# EasyEDA Pro project 第十四届蓝桥杯EDA国赛练习2.eprj, schematic SCH

## Sheets
1 POWER: Create Date: 2024-05-06; Page Name: POWER; Project Name: 第十四届蓝桥杯EDA国赛练习2; Schematic Name: SCH; Update Date: 2024-05-13
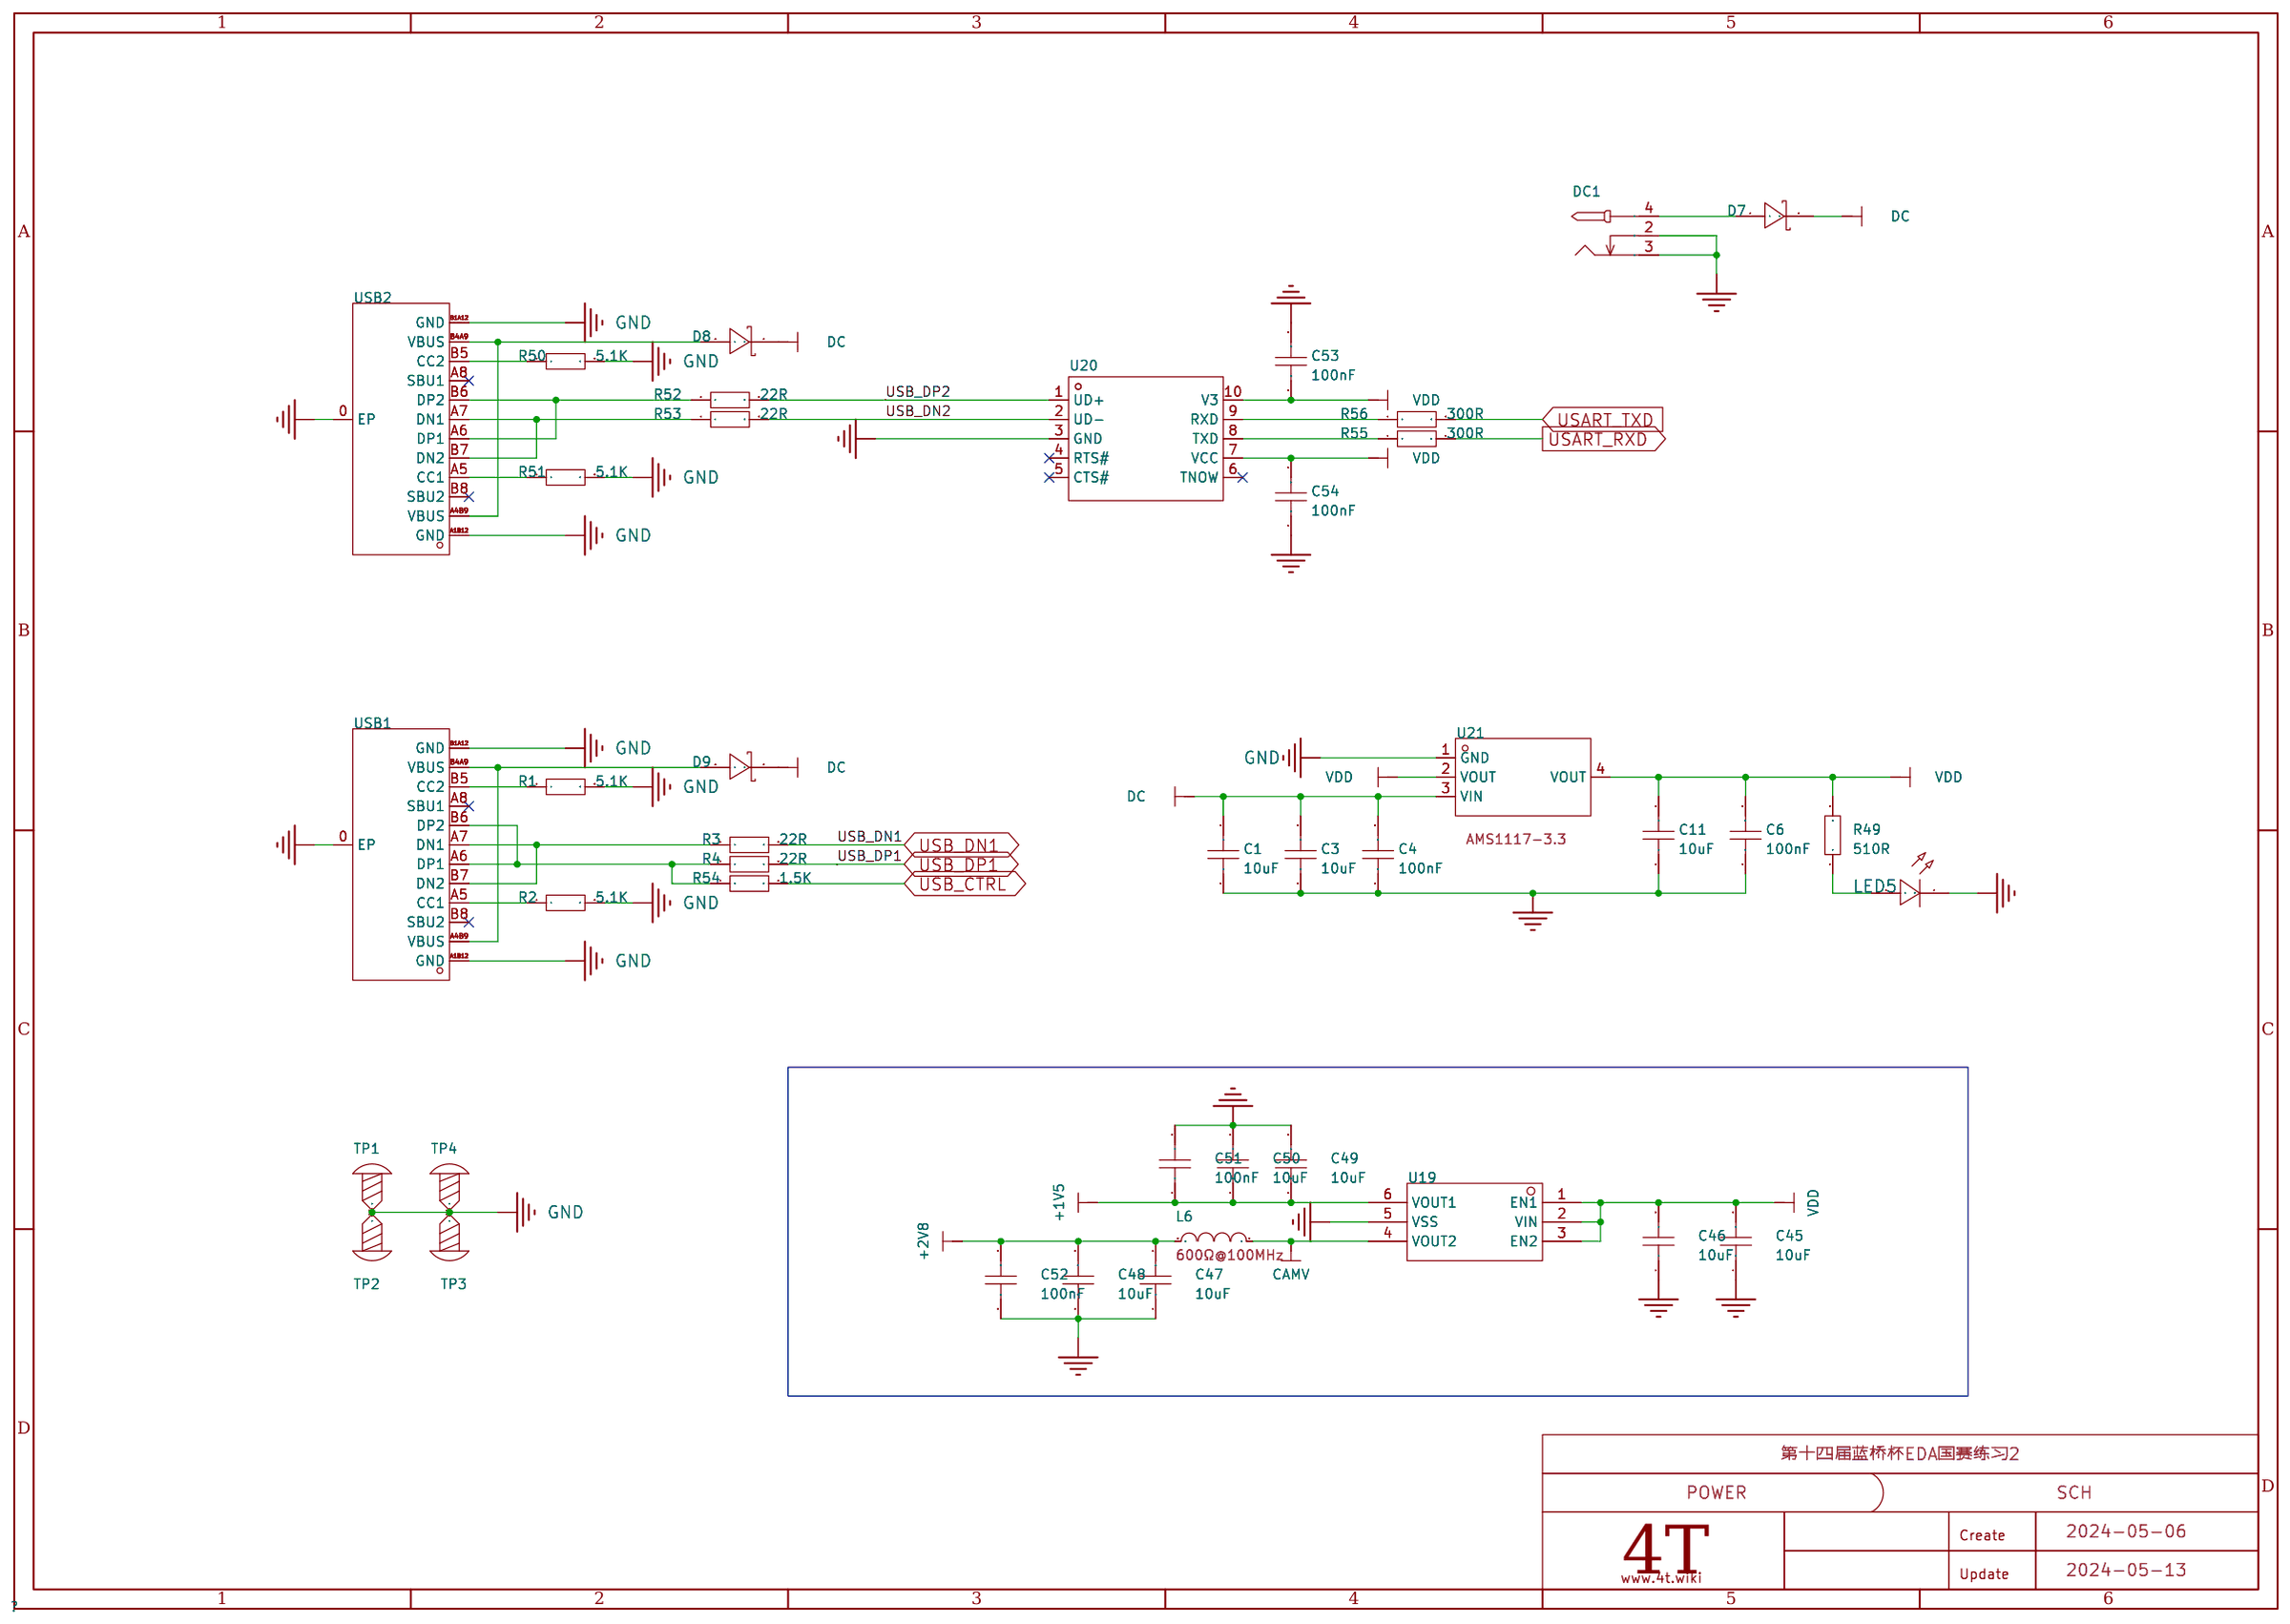
[diagram p0: POWER]
2 RELAY: Page Name: RELAY; Update Date: 2024-05-07
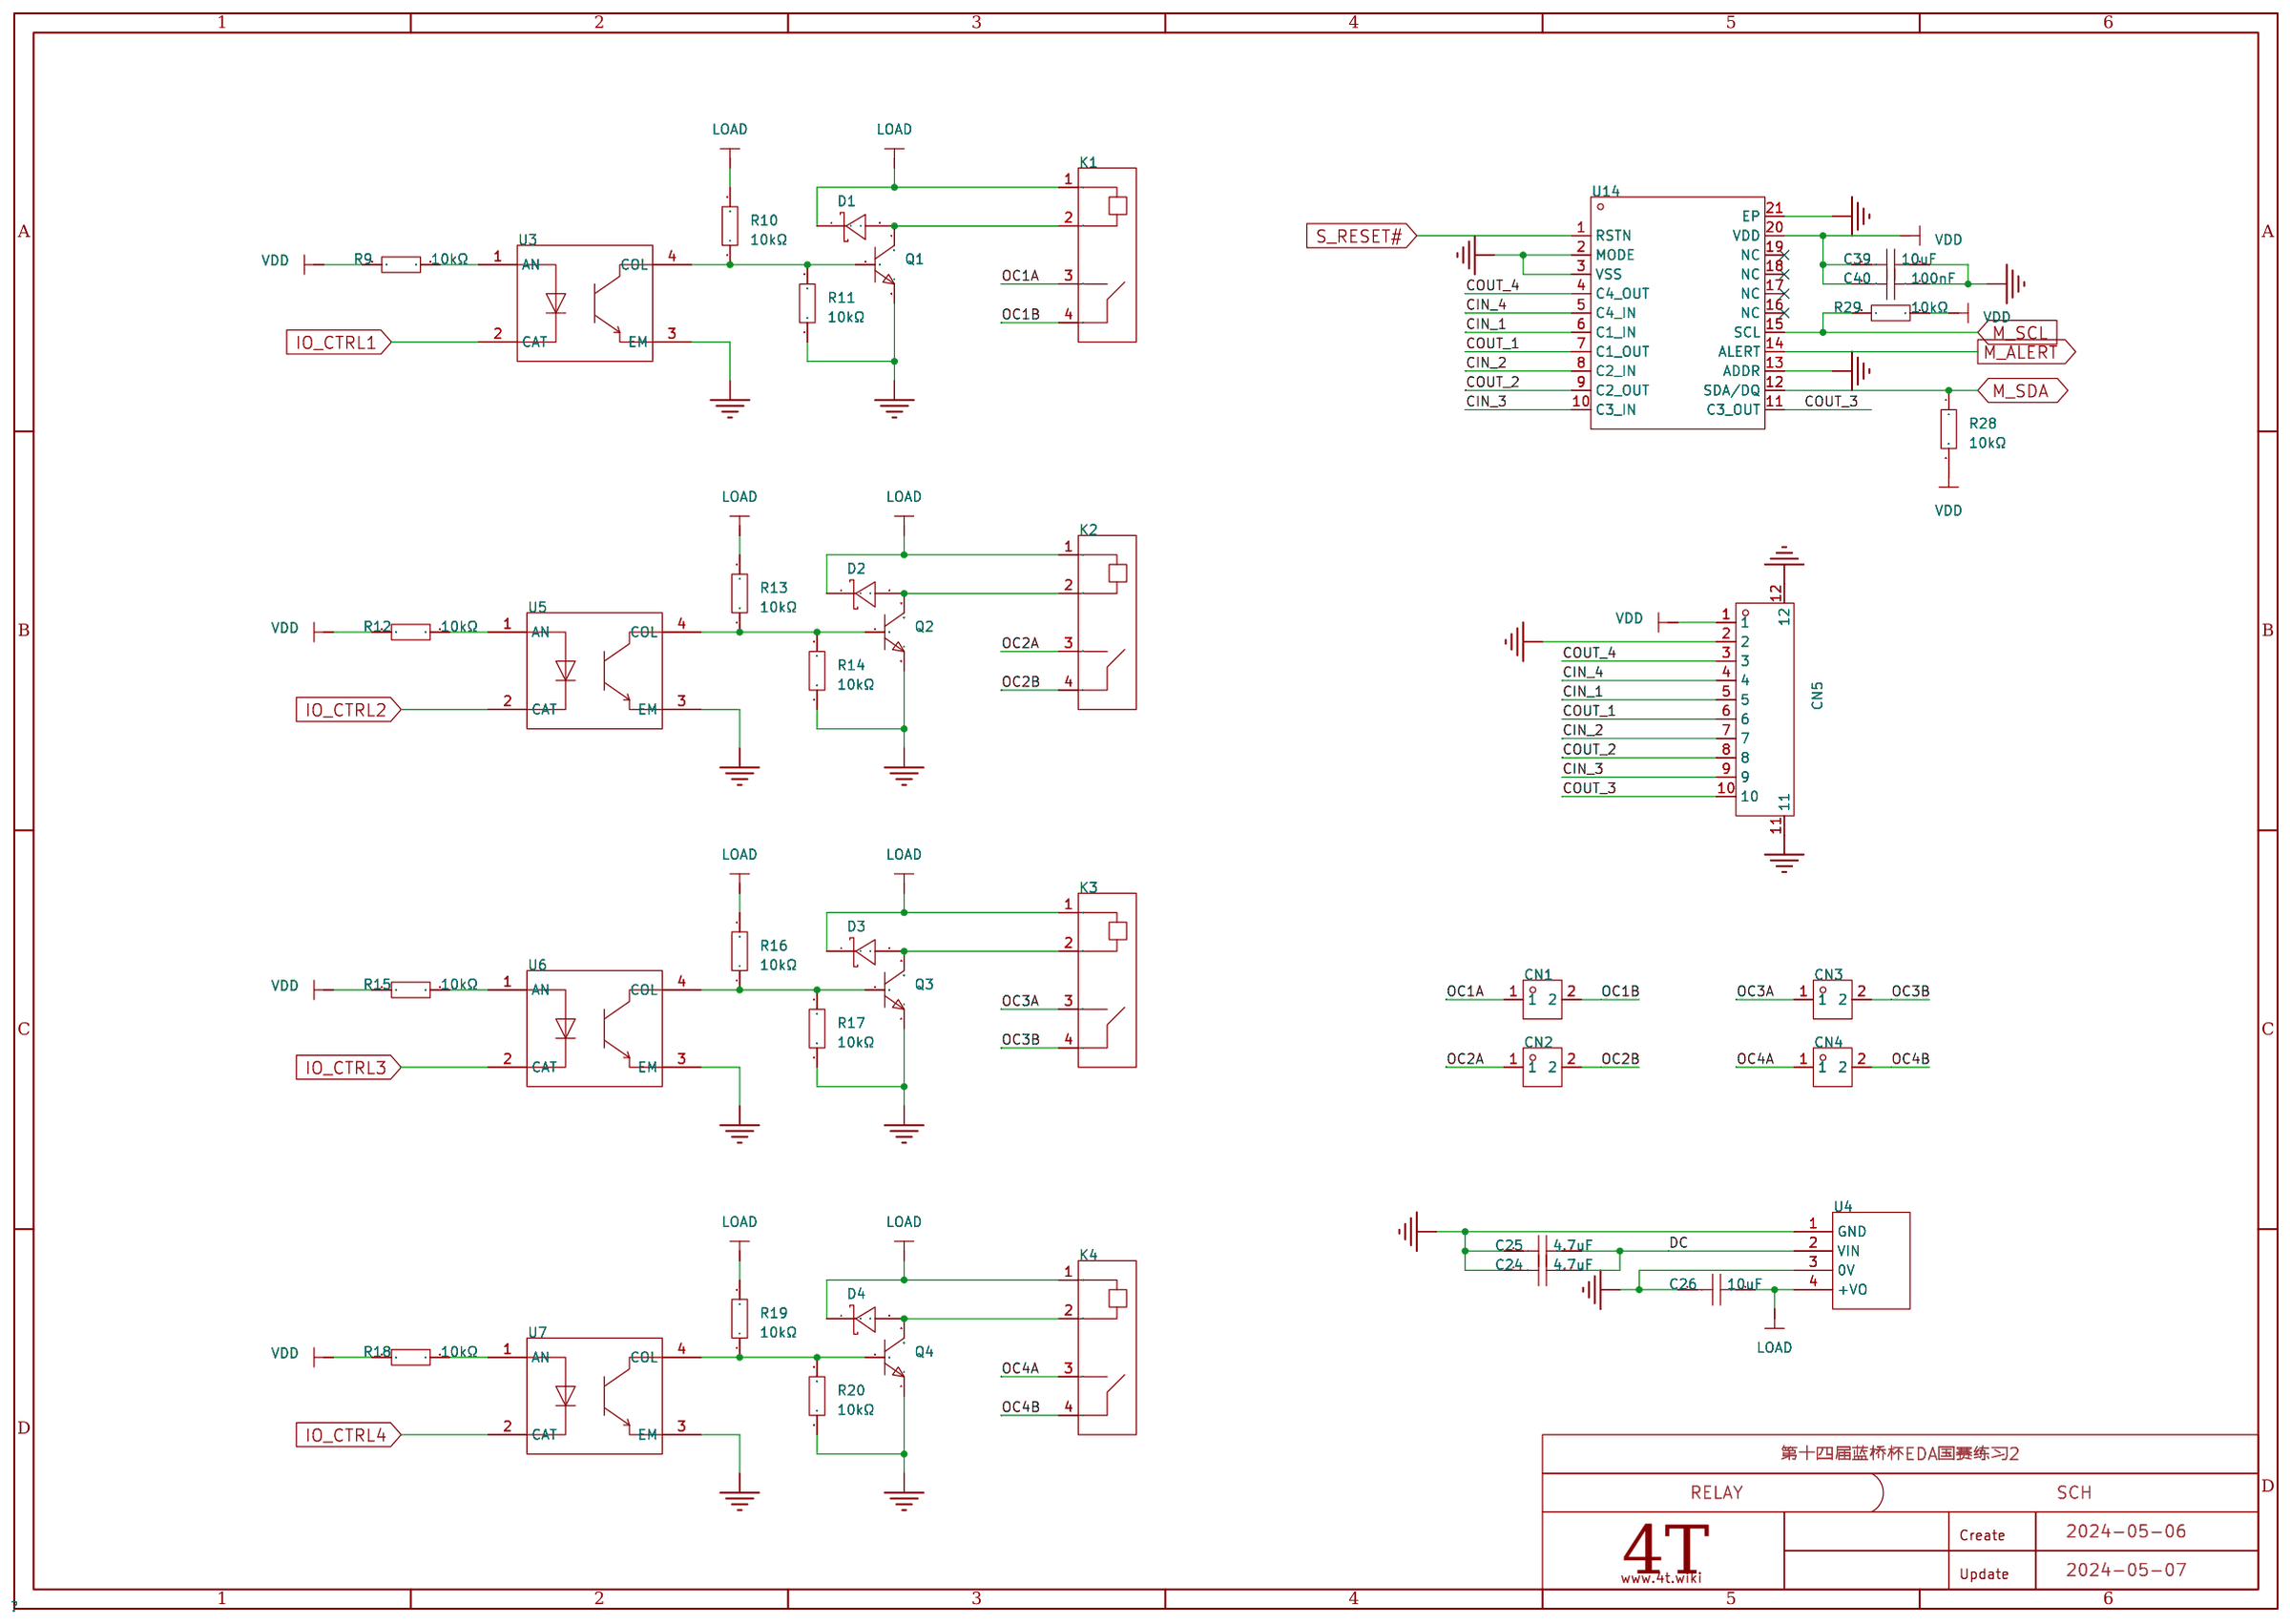
[diagram p1: RELAY]
3 MCU: Create Date: 2023-05-23; Page Name: MCU; Project Name: 14F_2023年5月20日; Update Date: 2023-05-24
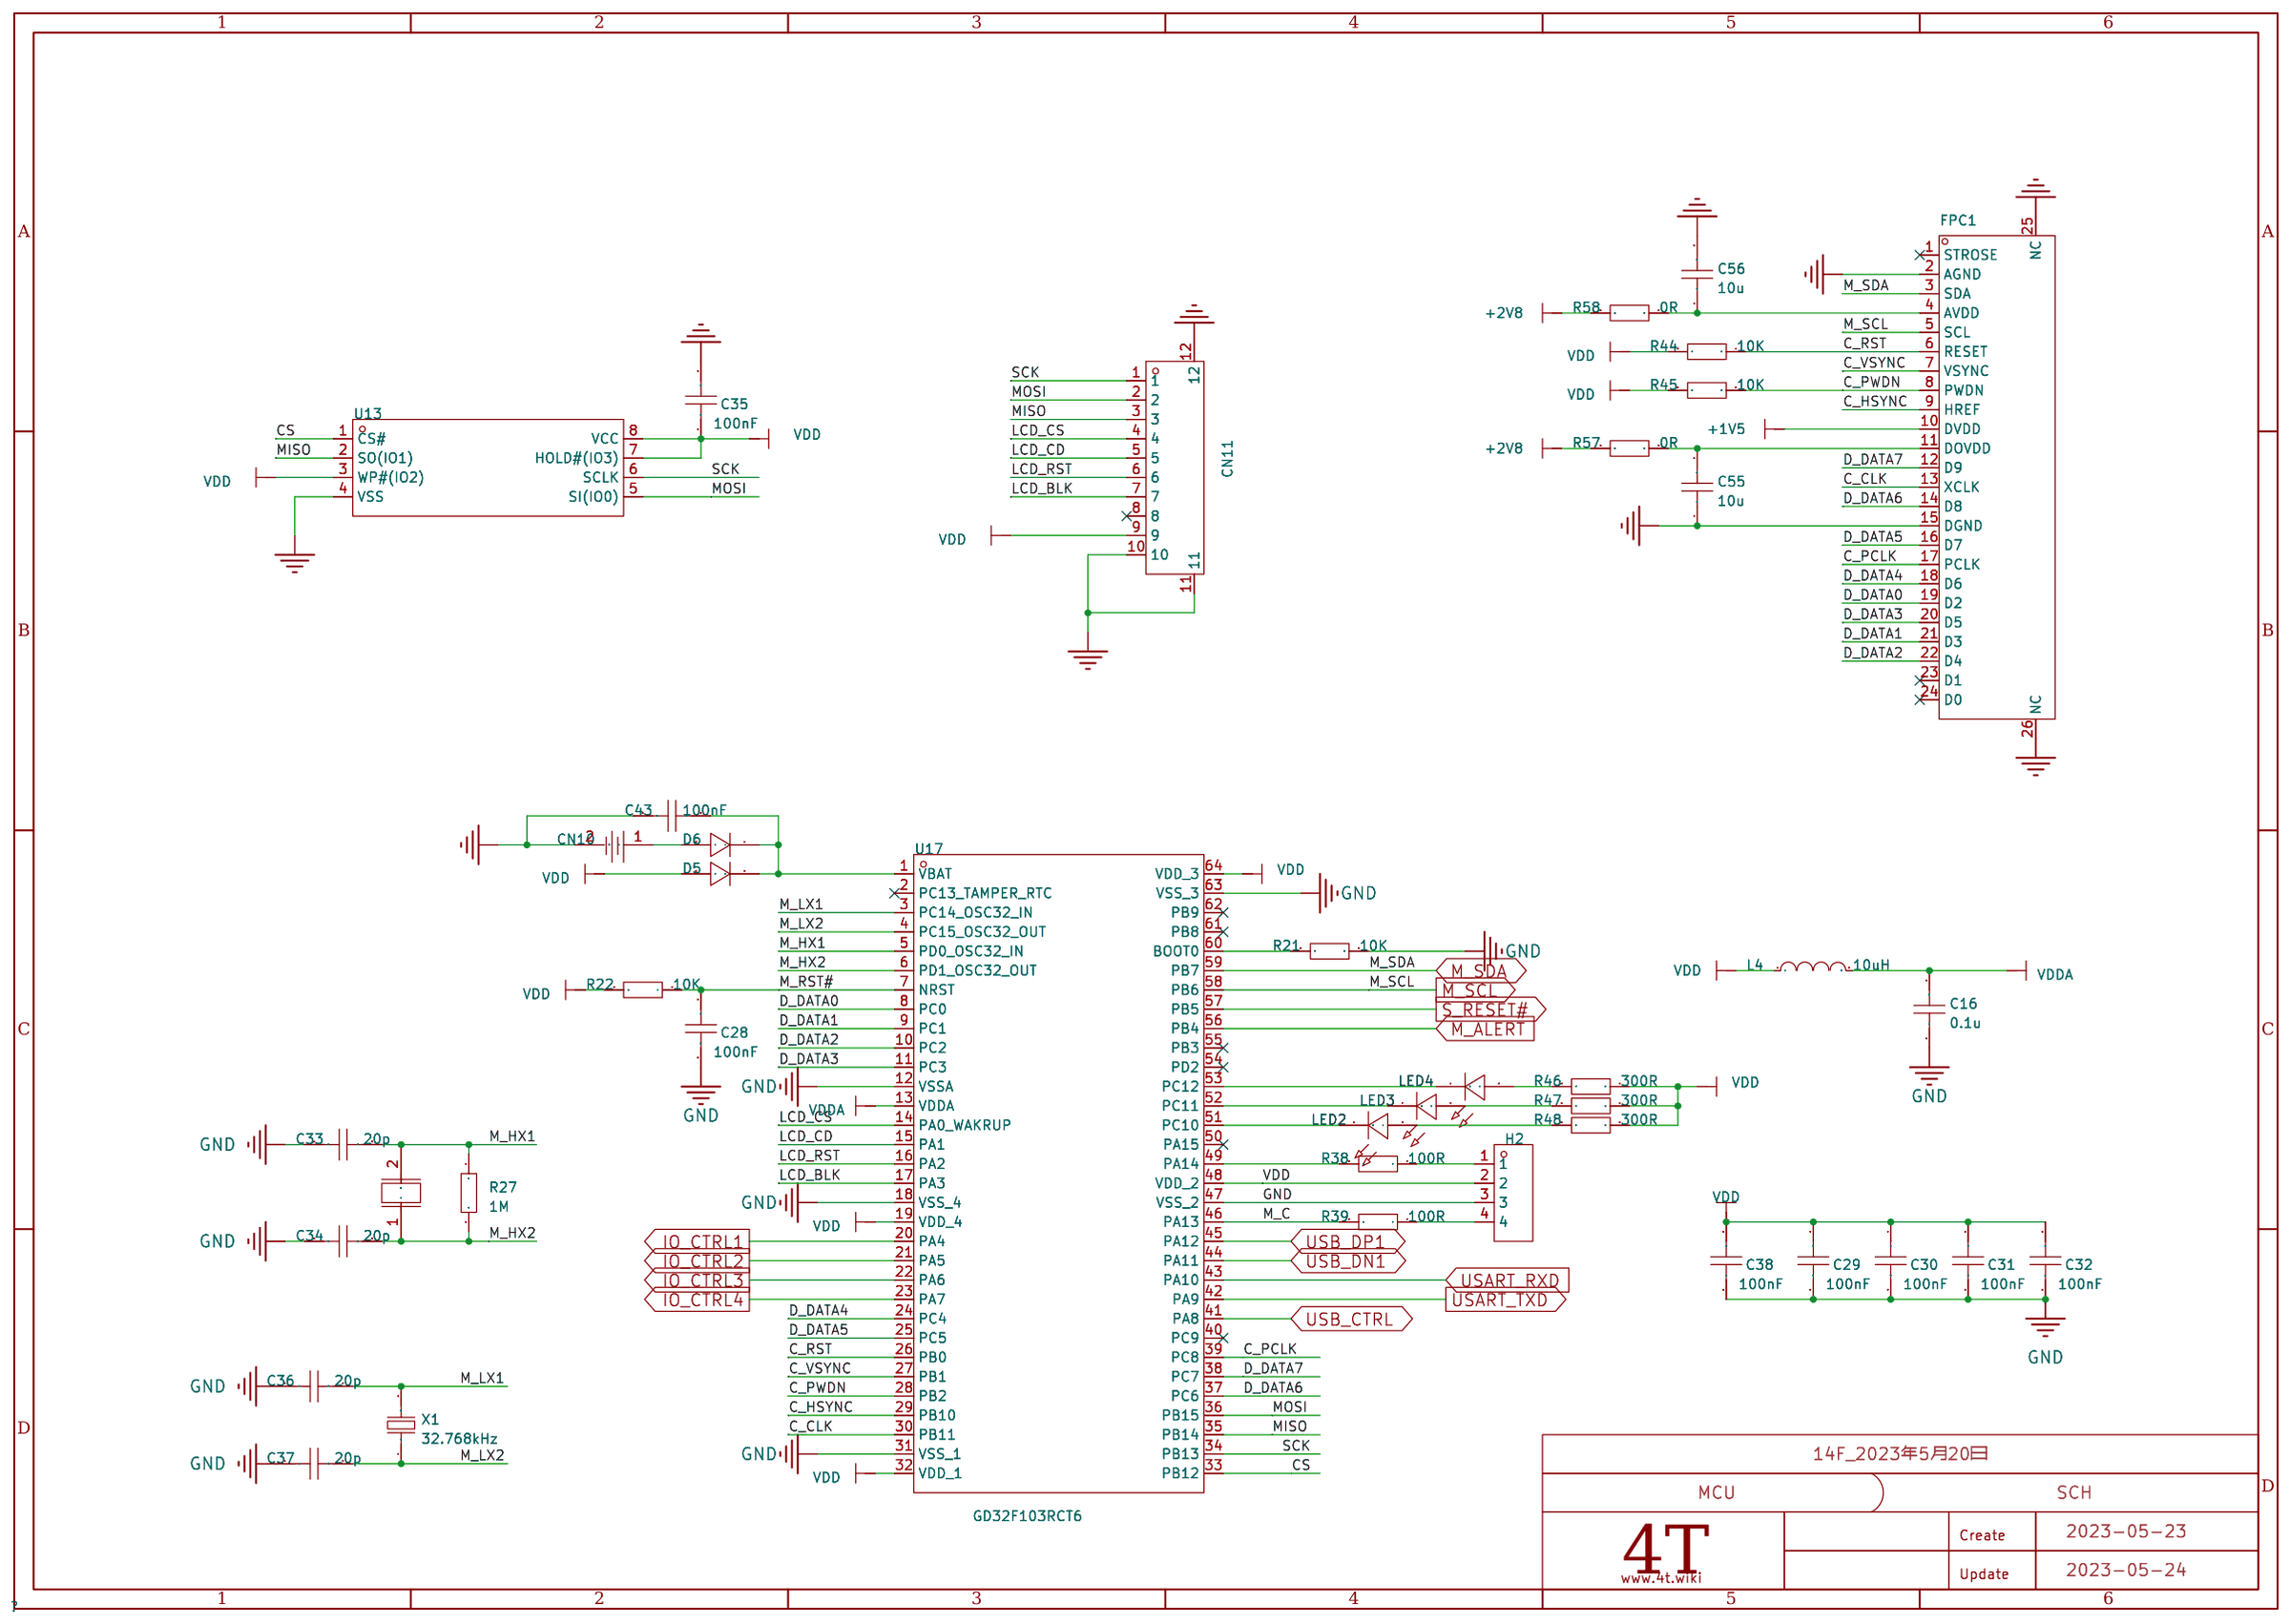
[diagram p2: MCU]

## Parts
sheet MCU
C16  0.1u  [C0805]
C28  100nF  [C0805]
C29  100nF  [C0805]
C30  100nF  [C0805]
C31  100nF  [C0805]
C32  100nF  [C0805]
C33  20p  [C0805]
C34  20p  [C0805]
C35  100nF  [C0805]
C36  20p  [C0805]
C37  20p  [C0805]
C38  100nF  [C0805]
C43  100nF  [C0805]
C55  10u  [C0805]
C56  10u  [C0805]
CN10  CR1220_B  [BAT-SMD_CR1220-2ZX]
CN11  KH-A1251WF-10A  [CONN_SMD_10P-P1.25_KINGHELM_KH-A1251WF-10A]
D5  1N4148WS  [SOD-323_L1.8-W1.3-LS2.5-RD]
D6  1N4148WS  [SOD-323_L1.8-W1.3-LS2.5-RD]
FPC1  F-FPC0M24P-C310  [FPC-SMD_P0.50-24P_XJ-FGS]
H2  2.54-1*4P母  [HDR-TH_4P-P2.54-V-F]
L4  10uH  [L0805]
LED2  -  [LED_0805]
LED3  -  [LED_0805]
LED4  -  [LED_0805]
R21  10K  [R0805]
R22  10K  [R0805]
R27  1M  [R0805]
R38  100R  [R0805]
R39  100R  [R0805]
R44  10K  [R0805]
R45  10K  [R0805]
R46  300R  [R0805]
R47  300R  [R0805]
R48  300R  [R0805]
R57  0R  [R0805]
R58  0R  [R0805]
U12  8M-5032-2P  [CRYSTAL-SMD_L5.0-W3.2]
U13  GD25Q16CSAG-SOP8_208MIL  [SOP-8_L5.2-W5.3-P1.27-LS7.9-BL]
U17  GD32F103RCT6  [LQFP-64_L10.0-W10.0-P0.50-LS12.0-BL]
X1  32.768kHz  [FC-135R_L3.2-W1.5]
sheet POWER
C1  10uF  [C0805]
C3  10uF  [C0805]
C4  100nF  [C0805]
C6  100nF  [C0805]
C11  10uF  [C0805]
C45  10uF  [C0805]
C46  10uF  [C0805]
C47  10uF  [C0805]
C48  10uF  [C0805]
C49  10uF  [C0805]
C50  10uF  [C0805]
C51  100nF  [C0805]
C52  100nF  [C0805]
C53  100nF  [C0805]
C54  100nF  [C0805]
D7  SS34  [SMA_L4.3-W2.6-LS5.0-RD]
D8  SS34  [SMA_L4.3-W2.6-LS5.0-RD]
D9  SS34  [SMA_L4.3-W2.6-LS5.0-RD]
DC1  -  [DC-2.0]
L6  BLM18AG601SN1D  [L0603]
LED5  -  [LED_0805]
R1  5.1K  [R0805]
R2  5.1K  [R0805]
R3  22R  [R0805]
R4  22R  [R0805]
R49  510R  [R0805]
R50  5.1K  [R0805]
R51  5.1K  [R0805]
R52  22R  [R0805]
R53  22R  [R0805]
R54  1.5K  [R0805]
R55  300R  [R0805]
R56  300R  [R0805]
TP1  -  [M3螺丝]
TP2  -  [M3螺丝]
TP3  -  [M3螺丝]
TP4  -  [M3螺丝]
U19  -  [SOT_DPV]
U20  CH340E  [MSOP-10_L3.0-W3.0-P0.50-LS5.0-BL]
U21  AMS1117-3.3  [SOT-223-3_L6.5-W3.4-P2.30-LS7.0-BR]
USB1  CQ-USB-TYPE-C16P母座四脚插板有柱  [USB-C-SMD_CQ-USB-TYPE-C]
USB2  CQ-USB-TYPE-C16P母座四脚插板有柱  [USB-C-SMD_CQ-USB-TYPE-C]
sheet RELAY
C24  4.7uF  [C0805]
C25  4.7uF  [C0805]
C26  10uF  [C0805]
C39  10uF  [C0805]
C40  100nF  [C0805]
CN1  KF128L-5.08-2P蓝色  [TH_KF128L-5.08-2P]
CN2  KF128L-5.08-2P蓝色  [TH_KF128L-5.08-2P]
CN3  KF128L-5.08-2P蓝色  [TH_KF128L-5.08-2P]
CN4  KF128L-5.08-2P蓝色  [TH_KF128L-5.08-2P]
CN5  KH-A1251WF-10A  [CONN_SMD_10P-P1.25_KINGHELM_KH-A1251WF-10A]
D1  SS14  [SMA_L4.2-W2.6-LS5.3-RD]
D2  SS14  [SMA_L4.2-W2.6-LS5.3-RD]
D3  SS14  [SMA_L4.2-W2.6-LS5.3-RD]
D4  SS14  [SMA_L4.2-W2.6-LS5.3-RD]
K1  HF49FD/012-1H12  [RELAY-TH_HF49FD-XXX-1H12-XXX]
K2  HF49FD/012-1H12  [RELAY-TH_HF49FD-XXX-1H12-XXX]
K3  HF49FD/012-1H12  [RELAY-TH_HF49FD-XXX-1H12-XXX]
K4  HF49FD/012-1H12  [RELAY-TH_HF49FD-XXX-1H12-XXX]
Q1  SS8050  [SOT-23-3_L2.9-W1.3-P1.90-LS2.4-BR]
Q2  SS8050  [SOT-23-3_L2.9-W1.3-P1.90-LS2.4-BR]
Q3  SS8050  [SOT-23-3_L2.9-W1.3-P1.90-LS2.4-BR]
Q4  SS8050  [SOT-23-3_L2.9-W1.3-P1.90-LS2.4-BR]
R9  10kΩ  [R0805]
R10  10kΩ  [R0805]
R11  10kΩ  [R0805]
R12  10kΩ  [R0805]
R13  10kΩ  [R0805]
R14  10kΩ  [R0805]
R15  10kΩ  [R0805]
R16  10kΩ  [R0805]
R17  10kΩ  [R0805]
R18  10kΩ  [R0805]
R19  10kΩ  [R0805]
R20  10kΩ  [R0805]
R28  10kΩ  [R0805]
R29  10kΩ  [R0805]
U3  TLP521-1XSM  [SMD-4_L4.6-W6.5-P2.54-LS10.2-BL]
U4  B0505S-1WR3  [PWRM-TH_B0503S-1WR3]
U5  TLP521-1XSM  [SMD-4_L4.6-W6.5-P2.54-LS10.2-BL]
U6  TLP521-1XSM  [SMD-4_L4.6-W6.5-P2.54-LS10.2-BL]
U7  TLP521-1XSM  [SMD-4_L4.6-W6.5-P2.54-LS10.2-BL]
U14  MDC04  [QFN-20_L3.0-W3.0-P0.40-BL-EP1.7]

## Library data of the parts
C1 C3 C4 C6 C11 C16 C45-C56 = CAP_0805: 容值:100nF;精度:±10%;额定电压:50V;温度系数:X7R;; Supplier Footprint: 0805
C28-C38 C43 = CAP_0603: Supplier Footprint: 0603
CN10 = CR1220_B: Supplier Part: C9900012049; Supplier Footprint: 1220; JLCPCB Part Class: 扩展库; Datasheet: https://atta.szlcsc.comnull; Supplier: LCSC
CN5 CN11 = KH-A1251WF-10A: 板载连接器MX1.25针座-10P卧贴编带，匹配KH-A1250H-10P-JK; LCSC Part Name: 板载连接器; Supplier Part: C4943304; Manufacturer: kinghelm(金航标); Supplier Footprint: SMD,P=1.25mm; JLCPCB Part Class: ExtendedPart; Datasheet: https://atta.szlcsc.com/upload/public/pdf/source/20220712/B394C9B5DF1E4B9762CA63DDD21DD1B3.pdf; Supplier: LCSC
D5 D6 = 1N4148WS_C2128: 二极管配置:独立式;功率:200mW;直流反向耐压(Vr):100V;平均整流电流(Io):150mA;正向压降(Vf):1.25V@150mA;反向电流(Ir):1uA@75V;反向恢复时间(trr):4ns;工作温度:+150℃@(Tj);; LCSC Part Name: 100V150mA4nsT4; Supplier Part: C2128; Manufacturer: CJ(江苏长电/长晶); Supplier Footprint: SOD-323; JLCPCB Part Class: 基础库; Datasheet: https://atta.szlcsc.com/upload/public/pdf/source/20140809/1457707208178.pdf; Supplier: LCSC; Diode Configuration: 独立式; Power Dissipation: 200mW; Reverse Voltage (Vr): 100V; Average Rectified Current (Io): 150mA; Forward Voltage (Vf@If): 1.25V@150mA; Reverse Leakage Current: 1uA@75V; Reverse Recovery Time (trr): 4ns; Operating Temperature: +150℃@(Tj)
FPC1 = F-FPC0M24P-C310: 间距:0.5mm;触点数量:24;锁定特性:翻盖式;安装类型:卧贴;触点类型:下接;; LCSC Part Name: FPC插座0.5mm间距24P翻盖式下接; Supplier Part: C132514; Manufacturer: Ckmtw(灿科盟); Supplier Footprint: SMD,P=0.5mm; JLCPCB Part Class: ExtendedPart; Datasheet: https://atta.szlcsc.com/upload/public/pdf/source/20180105/C132514_15151572869031234524.pdf; Supplier: LCSC; Pitch: 0.5mm; Number of Contacts: 24; Locking Feature: 翻盖式; Mounting Type: 卧贴; Contact Type: 下接; Height Above Board: 2mm; FFC, FCB Thickness: 0.3mm~0.3mm; Pin Type: IN
H2 = 2.54-1*4P母: 排数:单排;总孔位数:4;间距:2.54mm;插孔结构:1x4P;行距:-;安装类型:直插;圆孔/方孔:方孔;额定电流:3A;额定电压:-;插孔方向:顶部;塑高:-;触头材质:青铜;触头镀层:-;工作温度范围:-40℃~+105℃;焊接温度(最大值):-;; LCSC Part Name: 2.54mm1x4P; Supplier Part: C2718488; Manufacturer: BOOMELE(博穆精密); Supplier Footprint: 插件,P=2.54mm; JLCPCB Part Class: ExtendedPart; Datasheet: https://atta.szlcsc.com/upload/public/pdf/source/20210301/C2718488_F4427B881E42CAA8DDB0B1C12B3A522C.pdf; Supplier: LCSC; Number of Rows: 单排; Number of Holes: 4; Pitch: 2.54mm; Holes Structure: 1x4P; Mounting Type: 直插; Circular Hole / Square Hole: 方孔; Current Rating (Max): 3A; Holes Direction: 顶部; Contact Material: 青铜; Operating Temperature Range: -40℃~+105℃
L4 = L_0805: 电感值:10uH;精度:±10%;额定电流:15mA;饱和电流(Isat):-;直流电阻(DCR):1.15Ω;
LED2-LED4 = LED_0805-G: Supplier Footprint: 0805
R1-R4 R21 R22 R27 R38 R39 R44-R58 = Res_0805: Supplier Footprint: 0805
U12 = 8M-5032-2P: Supplier Part: C9900017580; Supplier Footprint: 8MHz; JLCPCB Part Class: 扩展库; Supplier: LCSC
U13 = GD25Q16CSAG-SOP8_208MIL: Supplier Part: C2891506; Supplier Footprint: SOP-8_L4.9-W3.9-P1.27-LS7.9; JLCPCB Part Class: 扩展库; Supplier: LCSC
U17 = GD32F103RCT6: CPU内核:ARMCortex-M3;CPU最大主频:108MHz;程序存储容量:256KB;程序存储器类型:FLASH;RAM总容量:48KB;GPIO端口数量:51;; LCSC Part Name: ARMCortex-M3108MHz; Supplier Part: C80687; Manufacturer: GigaDevice(兆易创新); Supplier Footprint: LQFP-64(10x10); JLCPCB Part Class: 扩展库; Datasheet: https://atta.szlcsc.com/upload/public/pdf/source/20160910/1473490292110.pdf; Supplier: LCSC; CPU Core: ARMCortex-M3; CPU Maximum Speed: 108MHz; Operating Voltage Range: 2.6V~3.6V; Program Storage Size: 256KB; Program Memory Type: FLASH; RAM Size: 48KB; EEPROM: 256KB; GPIO Ports Number: 51; ADC (Bit): 12bit; DAC (Bit): 12bit; PWM (Bit): 16bit; 16Bit Timer: 6; CAN: 1; UART/USART: 5; I2C: 2; SPI: 3; Universal Serial Bus: 有; Peripheral/Function: 片载温度传感器；DMA；看门狗；LIN总线协议；PWM；IrDA；SDIO；RTC实时时钟; Watchdog: 有; Real-Time Clock: 有; Infrared Data Association: 有; Secure Digital Input and Output: 有; Direct Memory Access: 有; Internal Oscillator: 有; Operating Temperature Range: -40℃~+85℃
X1 = Q13FC1350000400: 频率:32.768kHz;频率公差:±20ppm;负载电容:12.5pF;; LCSC Part Name: 32.768kHz±20ppm12.5pF; Supplier Part: C32346; Manufacturer: EPSON(爱普生); Supplier Footprint: SMD3215-2P; JLCPCB Part Class: 基础库; Datasheet: https://atta.szlcsc.com/upload/public/pdf/source/20190108/C32346_746D6B07EAF90824457A96480007685F.pdf; Supplier: LCSC; Crystal Type: 贴片无源晶振; Frequency Tolerance: ±20ppm; Load Capacitance: 12.5pF; Equivalent Series Resistance (ESR): 70kΩ; Operating Temperature: -40℃~+85℃
D7-D9 = SS34: Supplier Part: C9900023345; Supplier Footprint: SMA,DO-214AC; JLCPCB Part Class: 扩展库; Datasheet: 2022-07-04/534833A/5ff3008f79ea4c6ab22b1f3463cee262/20210714020425519.pdf; Supplier: LCSC
DC1 = DC-005_2.0: Supplier Footprint: 插件
L6 = BLM18AG601SN1D: 标称阻抗@测试频率:600Ω@100MHz;误差:±25%;直流电阻(RDC):380mΩ;额定电流:500mA;电路数:1;; LCSC Part Name: 600Ω@100MHz±25%; Supplier Part: C19330; Manufacturer: muRata(村田); Supplier Footprint: 0603; JLCPCB Part Class: 扩展库; Datasheet: https://atta.szlcsc.com/upload/public/pdf/source/20180326/C19330_93F4AC33FF94C8E22511353688ADC0FA.pdf; Supplier: LCSC; Impedance @ Frequency: 600Ω@100MHz; Tolerance: ±25%; DC Resistance: 380mΩ; Current Rating: 500mA; Circuits: 1
LED5 = LED_0805-R: Supplier Footprint: 0805
TP1-TP4 = M3螺丝: Supplier Footprint: 插件
U19 = DPV
U20 = CH340E: 应用功能:收发器;接口协议:USB2.0;数据速率:2Mbps;; LCSC Part Name: USB转串口芯片CH340; Supplier Part: C99652; Manufacturer: WCH(南京沁恒); Supplier Footprint: MSOP-10; JLCPCB Part Class: 扩展库; Datasheet: https://atta.szlcsc.com/upload/public/pdf/source/20200819/C99652_97FFC0DF2539BFF05CD752AD9221D632.pdf; Supplier: LCSC; Applications Function: 收发器; Protocol: USB2.0; Data Rate: 2Mbps; Supply Voltage: 3.3V；5V
U21 = AMS1117-3.3_C6186: 输出类型:固定;输出极性:正;最大输入电压:-;输出电压:3.3V;输出电流:1A;电源纹波抑制比(PSRR):72dB@(120Hz);; LCSC Part Name: 输出3.3V1A; Supplier Part: C6186; Manufacturer: AMS; Supplier Footprint: SOT-223; JLCPCB Part Class: 基础库; Datasheet: https://atta.szlcsc.com/upload/public/pdf/source/20180727/C6186_7A095716F0823C02F1997A905E26C086.pdf; Supplier: LCSC; Output Type: 固定; Output Polarity: 正; Number of Outputs: 1; Output Voltage: 3.3V; Dropout Voltage: 1.3V@(800mA); Output Current: 1A; Power Supply Rejection Ratio (PSRR): 72dB@(120Hz)
USB1 USB2 = CQ-USB- TYPE-C 16P母座四脚插板有柱: Supplier Part: C9900026759; Supplier Footprint: USB-TYPE-C-SMD-16P; JLCPCB Part Class: 扩展库; Datasheet: https://atta.szlcsc.comnull; Supplier: LCSC
C24-C26 C39 C40 = CAP_0805: Supplier Footprint: 0805
CN1-CN4 = KF128L-5.08-2P 蓝色: Supplier Part: C2916931; Supplier Footprint: 5.08-2P; JLCPCB Part Class: 扩展库; Supplier: LCSC
D1-D4 = SS14_C2480: 二极管配置:独立式;直流反向耐压(Vr):40V;平均整流电流(Io):1A;正向压降(Vf):550mV@1A;反向电流(Ir):500uA@40V;; LCSC Part Name: 40V1A550mV@1A框架工艺; Supplier Part: C2480; Manufacturer: MDD; Supplier Footprint: SMA(DO-214AC); JLCPCB Part Class: 基础库; Datasheet: https://atta.szlcsc.com/upload/public/pdf/source/20230314/CB2C302F91CEFB8A73D1DF7B261C7D58.pdf; Supplier: LCSC; Diode Configuration: 独立式; Reverse Voltage (Vr): 40V; Average Rectified Current (Io): 1A; Forward Voltage (Vf@If): 550mV@1A; Reverse Leakage Current (Ir): 500uA@40V
K1-K4 = HF49FD/012-1H12: 线圈电压:12V;线圈类型:非极化-单线圈;触点形式:一组常开:1A(单刀单掷-常开);最大切换电流:5A;触点材料:AgNi;; LCSC Part Name: 宏发继电器; Supplier Part: C399491; Manufacturer: HF(宏发); Supplier Footprint: SIP-4; JLCPCB Part Class: 扩展库; Datasheet: https://atta.szlcsc.com/upload/public/pdf/source/20190620/C399491_B2190B02DDD565265172868420E7880D.pdf; Supplier: LCSC; Coil Voltage: 12V; Coil Type: 非极化-单线圈; Pin Number: 4; Contact Form: 一组常开:1A(单刀单掷-常开); Maximum Switching Current: 5A; Maximum Switching Voltage: 250V@AC；30V@DC; Coil Rated Power: 120mW; Contact Rating: 5A@30VDC；5A@250VAC; Coil Resistance: 1.2kΩ; Operate Time: 10ms; Release Time: 5ms; Contact Resistance: 100mΩ; Contact Material: AgNi; Operating Temperature: -40℃~+85℃
Q1-Q4 = SS8050_C2150: 晶体管类型:NPN;集射极击穿电压(Vceo):25V;集电极电流(Ic):1.5A;功率(Pd):300mW;直流电流增益(hFE@Ic,Vce):200@100mA,1V;; LCSC Part Name: NPN25V1.5AY1200-350; Supplier Part: C2150; Manufacturer: CJ(江苏长电/长晶); Supplier Footprint: SOT-23; JLCPCB Part Class: 基础库; Datasheet: https://atta.szlcsc.com/upload/public/pdf/source/20230322/AEE86F4B043774EFF80CAEA14A37D9E9.pdf; Supplier: LCSC; Transistor Type: NPN; Collector-Emitter Breakdown Voltage (Vceo): 25V; Collector Current (Ic): 1.5A; Power Dissipation (Pd): 300mW; Collector Cut-Off Current (Icbo): 100nA; Collector-Emitter Saturation Voltage (VCE(sat)@Ic,Ib): 500mV@800mA,80mA; DC Current Gain (hFE@Ic,Vce): 200@100mA,1V; Transition Frequency (fT): 100MHz; Operating Temperature: +150℃@(Tj)
R9-R20 R28 R29 = 0805W8F1002T5E_C17414: 电阻类型:厚膜电阻;阻值:10kΩ;精度:±1%;功率:125mW;; LCSC Part Name: 10kΩ±1%125mW; Supplier Part: C17414; Manufacturer: UNI-ROYAL(厚声); Manufacturer Part: 0805W8F1002T5E; Supplier Footprint: 0805; JLCPCB Part Class: BasicPart; Datasheet: https://atta.szlcsc.com/upload/public/pdf/source/20200306/C422600_1E6D84923E4A46A82E41ADD87F860B5C.pdf; Supplier: LCSC; Type: 厚膜电阻; Tolerance: ±1%; Power(Watts): 125mW; Temperature Coefficient: ±100ppm/℃; Overload Voltage (Max): 150V; Operating Temperature Range: -55℃~+155℃
U3 U5-U7 = TLP521-1XSM: 输入电压类型:DC;输出通道数:1;正向电压:1.15V;反向电压:6V;输出电流:50mA;接收端电压:55V;集射极饱和电压(Vce(sat)@Ic,IF):400mV@2.4mA,8mA;隔离电压(rms):5.3kV;; LCSC Part Name: DC输入隔离电压(rms):5300V; Supplier Part: C83157; Manufacturer: ISOCOM(英国安数光); Supplier Footprint: SMD-4P; JLCPCB Part Class: 扩展库; Datasheet: https://atta.szlcsc.com/upload/public/pdf/source/20181205/C83157_755450129BF4CC137580CACDD5B9451F.pdf; Supplier: LCSC; Input voltage type: DC; Output Type: 光电三极管; Number of Outputs: 1; Forward Voltage: 1.15V; Reverse Voltage: 6V; Output Current: 50mA; Receiving End Voltage: 55V; Collector-Emitter Saturation Voltage (Vce(sat)@Ic,IF): 400mV@2.4mA,8mA; Rise time: 4us@2mA,100Ω; Fall time: 3us@2mA,100Ω; Isolation Voltage(rms): 5.3kV; Operating Temperature: -30℃~+100℃
U4 = B0505S-1WR3: 电压输出的组数:-;最大输入电压:-;输出电压:-;输出电流（最大值/满载）:-;; Supplier Part: C382179; Manufacturer: Taisko(台思科); Supplier Footprint: ThroughHole; JLCPCB Part Class: 扩展库; Datasheet: https://atta.szlcsc.com/upload/public/pdf/source/20190730/C382179_FFA5879528856A2CD72435973011A927.pdf; Supplier: LCSC
U14 = MDC04: 测量范围0~119pF接口I?C测量速度3~20ms分辨率0.1fF供电电压2.0V~5.5V平均功耗4.5μA通道数4; LCSC Part Name: I2C接口&amp;单总线高精度数字电容传感器; Supplier Part: C2843541; Manufacturer: Mysentech(敏源传感); Supplier Footprint: QFN-20-EP(3x3); JLCPCB Part Class: 扩展库; Datasheet: https://atta.szlcsc.com/upload/public/pdf/source/20210825/654D83FD6FE4FC7E7E5C48FB3397AD56.pdf; Supplier: LCSC

## Nets
+1V5: C49.1 C50.1 C51.1 FPC1.10(DVDD) U19.6(VOUT1)
+2V8: C47.2 C48.2 C52.2 L6.2 R57.2 R58.2
GND: C1.1 C3.1 C4.1 C6.1 C11.1 C16.1 C24.1 C25.1 C28.2 C29.2 C30.2 C31.2 C32.2 C33.1 C34.1 C35.1 C36.1 C37.1 C38.2 C39.2 C40.1 C43.2 C45.1 C46.1 C47.1 C48.1 C49.2 C50.2 C51.2 C52.1 C53.2 C54.1 C55.1 C56.2 CN5.2 CN5.11 CN5.12 CN10.2 CN11.10 CN11.11 CN11.12 DC1.2 DC1.3 FPC1.2(AGND) FPC1.15(DGND) FPC1.25(NC) FPC1.26(NC) H2.3 LED5.1(C) R1.2 R2.2 R21.1 R50.2 R51.2 TP1.1 TP2.1 TP3.1 TP4.1 U4.1(GND) U13.4(VSS) U14.2(MODE) U14.3(VSS) U14.13(ADDR) U14.21(EP) U17.12(VSSA) U17.18(VSS_4) U17.31(VSS_1) U17.47(VSS_2) U17.63(VSS_3) U19.5(VSS) U20.3(GND) U21.1(GND) USB1.0(EP) USB1.A1B12(GND) USB1.B1A12(GND) USB2.0(EP) USB2.A1B12(GND) USB2.B1A12(GND)
VDD: C6.2 C11.2 C29.1 C30.1 C31.1 C32.1 C35.2 C38.1 C39.1 C40.2 C45.2 C46.2 C53.1 C54.2 CN5.1 CN11.9 D5.2(A) H2.2 L4.1 R9.1 R12.1 R15.1 R18.1 R22.2 R28.2 R29.1 R44.2 R45.2 R46.1 R47.1 R48.1 R49.2 U13.3(WP#(IO2)) U13.7(HOLD#(IO3)) U13.8(VCC) U14.20(VDD) U17.19(VDD_4) U17.32(VDD_1) U17.48(VDD_2) U17.64(VDD_3) U19.1(EN1) U19.2(VIN) U19.3(EN2) U20.7(VCC) U20.10(V3) U21.2(VOUT) U21.4(VOUT)
VDDA: C16.2 L4.2 U17.13(VDDA)
0: C26.2 Q1.2(E) Q2.2(E) Q3.2(E) Q4.2(E) R11.1 R14.1 R17.1 R20.1 U3.3(EM) U4.3(0V) U5.3(EM) U6.3(EM) U7.3(EM)
C_CLK: FPC1.13(XCLK) U17.30(PB11)
C_HSYNC: FPC1.9(HREF) U17.29(PB10)
C_PCLK: FPC1.17(PCLK) U17.39(PC8)
C_PWDN: FPC1.8(PWDN) R45.1 U17.28(PB2)
C_RST: FPC1.6(RESET) R44.1 U17.26(PB0)
C_VSYNC: FPC1.7(VSYNC) U17.27(PB1)
CAMV: L6.1 U19.4(VOUT2)
CIN_1: CN5.5 U14.6(C1_IN)
CIN_2: CN5.7 U14.8(C2_IN)
CIN_3: CN5.9 U14.10(C3_IN)
CIN_4: CN5.4 U14.5(C4_IN)
COUT_1: CN5.6 U14.7(C1_OUT)
COUT_2: CN5.8 U14.9(C2_OUT)
COUT_3: CN5.10 U14.11(C3_OUT)
COUT_4: CN5.3 U14.4(C4_OUT)
CS: U13.1(CS#) U17.33(PB12)
D_DATA0: FPC1.19(D2) U17.8(PC0)
D_DATA1: FPC1.21(D3) U17.9(PC1)
D_DATA2: FPC1.22(D4) U17.10(PC2)
D_DATA3: FPC1.20(D5) U17.11(PC3)
D_DATA4: FPC1.18(D6) U17.24(PC4)
D_DATA5: FPC1.16(D7) U17.25(PC5)
D_DATA6: FPC1.14(D8) U17.37(PC6)
D_DATA7: FPC1.12(D9) U17.38(PC7)
DC: C1.2 C3.2 C4.2 C24.2 C25.2 D7.1(K) D8.1(K) D9.1(K) U4.2(VIN) U21.3(VIN)
IO_CTRL1: U3.2(CAT) U17.20(PA4)
IO_CTRL2: U5.2(CAT) U17.21(PA5)
IO_CTRL3: U6.2(CAT) U17.22(PA6)
IO_CTRL4: U7.2(CAT) U17.23(PA7)
LCD_BLK: CN11.7 U17.17(PA3)
LCD_CD: CN11.5 U17.15(PA1)
LCD_CS: CN11.4 U17.14(PA0_WAKRUP)
LCD_RST: CN11.6 U17.16(PA2)
LOAD: C26.1 D1.1(K) D2.1(K) D3.1(K) D4.1(K) K1.1 K2.1 K3.1 K4.1 R10.2 R13.2 R16.2 R19.2 U4.4(+VO)
M_ALERT: U14.14(ALERT) U17.56(PB4)
M_C: R39.2 U17.46(PA13)
M_HX1: C33.2 R27.1 U12.2 U17.5(PD0_OSC32_IN)
M_HX2: C34.2 R27.2 U12.1 U17.6(PD1_OSC32_OUT)
M_LX1: C36.2 U17.3(PC14_OSC32_IN) X1.2
M_LX2: C37.2 U17.4(PC15_OSC32_OUT) X1.1
M_RST#: C28.1 R22.1 U17.7(NRST)
M_SCL: FPC1.5(SCL) R29.2 U14.15(SCL) U17.58(PB6)
M_SDA: FPC1.3(SDA) R28.1 U14.12(SDA/DQ) U17.59(PB7)
MISO: CN11.3 U13.2(SO(IO1)) U17.35(PB14)
MOSI: CN11.2 U13.5(SI(IO0)) U17.36(PB15)
OC1A: CN1.1 K1.3
OC1B: CN1.2 K1.4
OC2A: CN2.1 K2.3
OC2B: CN2.2 K2.4
OC3A: CN3.1 K3.3
OC3B: CN3.2 K3.4
OC4A: CN4.1 K4.3
OC4B: CN4.2 K4.4
S_RESET#: U14.1(RSTN) U17.57(PB5)
SCK: CN11.1 U13.6(SCLK) U17.34(PB13)
USART_RXD: R55.2 U17.43(PA10)
USART_TXD: R56.2 U17.42(PA9)
USB_CTRL: R54.2 U17.41(PA8)
USB_DN1: R3.2 U17.44(PA11)
USB_DN2: R53.2 U20.2(UD-)
USB_DP1: R4.2 U17.45(PA12)
USB_DP2: R52.2 U20.1(UD+)
$1N757: R1.1 USB1.B5(CC2)
$1N782: R2.1 USB1.A5(CC1)
$1N965: D9.2(A) USB1.A4B9(VBUS) USB1.B4A9(VBUS)
$1N986: R3.1 USB1.A7(DN1) USB1.B7(DN2)
$1N5837: LED5.2(A) R49.1
$1N6125: R51.1 USB2.A5(CC1)
$1N6128: R50.1 USB2.B5(CC2)
$1N6129: D8.2(A) USB2.A4B9(VBUS) USB2.B4A9(VBUS)
$1N6270: R52.1 USB2.A6(DP1) USB2.B6(DP2)
$1N6277: R53.1 USB2.A7(DN1) USB2.B7(DN2)
$1N6306: R4.1 R54.1 USB1.A6(DP1) USB1.B6(DP2)
$1N6538: R55.1 U20.8(TXD)
$1N6566: R56.1 U20.9(RXD)
$1N7582: D7.2(A) DC1.4
$2N490: R9.2 U3.1(AN)
$2N1169: Q1.1(B) R10.1 R11.2 U3.4(COL)
$2N1323: D1.2(A) K1.2 Q1.3(C)
$2N1681: R12.2 U5.1(AN)
$2N1686: Q2.1(B) R13.1 R14.2 U5.4(COL)
$2N1700: D2.2(A) K2.2 Q2.3(C)
$2N2005: R15.2 U6.1(AN)
$2N2010: Q3.1(B) R16.1 R17.2 U6.4(COL)
$2N2024: D3.2(A) K3.2 Q3.3(C)
$2N2329: R18.2 U7.1(AN)
$2N2334: Q4.1(B) R19.1 R20.2 U7.4(COL)
$2N2348: D4.2(A) K4.2 Q4.3(C)
$3N3779: CN10.1 D6.2(A)
$3N4170: H2.1 R38.1
$3N4171: H2.4 R39.1
$3N4361: R21.2 U17.60(BOOT0)
$3N4426: C43.1 D5.1(K) D6.1(K) U17.1(VBAT)
$3N5935: R38.2 U17.49(PA14)
$3N8528: LED2.1(C) U17.51(PC10)
$3N8530: LED3.1(C) U17.52(PC11)
$3N8532: LED4.1(C) U17.53(PC12)
$3N8599: LED4.2(A) R46.2
$3N8602: LED3.2(A) R47.2
$3N8605: LED2.2(A) R48.2
$3N13768: C55.2 FPC1.11(DOVDD) R57.1
$3N13829: C56.1 FPC1.4(AVDD) R58.1

Not connected (* = marked no-connect by the designer): CN11 8*; FPC1 1(STROSE)* 23(D1)* 24(D0)*; U14 16(NC)* 17(NC)* 18(NC)* 19(NC)*; U17 2(PC13_TAMPER_RTC)* 40(PC9)* 50(PA15)* 54(PD2)* 55(PB3)* 61(PB8)* 62(PB9)*; U20 4(RTS#)* 5(CTS#)* 6(TNOW)*; USB1 A8(SBU1)* B8(SBU2)*; USB2 A8(SBU1)* B8(SBU2)*
